# EAGLE schematic Resistor_Resistor (EAGLE 8.3.0), part 22 of 43
## Parts (continued)
R30118  10K  RESISTOR_0201  [0201]
R30119  10K  RESISTOR_0201  [0201]
R30120  10K  RESISTOR_0201  [0201]
R30121  10K  RESISTOR_0201  [0201]
R30122  10K  RESISTOR_0201  [0201]
R30123  10K  RESISTOR_0201  [0201]
R30124  10K  RESISTOR_0201  [0201]
R30125  10K  RESISTOR_0201  [0201]
R30126  10K  RESISTOR_0201  [0201]
R30127  10K  RESISTOR_0201  [0201]
R30128  10K  RESISTOR_0201  [0201]
R30129  10K  RESISTOR_0201  [0201]
R30130  10K  RESISTOR_0201  [0201]
R30131  10K  RESISTOR_0201  [0201]
R30132  10K  RESISTOR_0201  [0201]
R30133  10K  RESISTOR_0201  [0201]
R30134  10K  RESISTOR_0201  [0201]
R30135  10K  RESISTOR_0201  [0201]
R30136  10K  RESISTOR_0201  [0201]
R30137  10K  RESISTOR_0201  [0201]
R30138  10K  RESISTOR_0201  [0201]
R30139  10K  RESISTOR_0201  [0201]
R30140  10K  RESISTOR_0201  [0201]
R30141  10K  RESISTOR_0201  [0201]
R30142  10K  RESISTOR_0201  [0201]
R30143  10K  RESISTOR_0201  [0201]
R30144  10K  RESISTOR_0201  [0201]
R30145  10K  RESISTOR_0201  [0201]
R30146  10K  RESISTOR_0201  [0201]
R30147  10K  RESISTOR_0201  [0201]
R30148  10K  RESISTOR_0201  [0201]
R30149  10K  RESISTOR_0201  [0201]
R30150  10K  RESISTOR_0201  [0201]
R30151  10K  RESISTOR_0201  [0201]
R30152  10K  RESISTOR_0201  [0201]
R30153  10K  RESISTOR_0201  [0201]
R30154  10K  RESISTOR_0201  [0201]
R30155  10K  RESISTOR_0201  [0201]
R30156  10K  RESISTOR_0201  [0201]
R30157  10K  RESISTOR_0201  [0201]
R30158  10K  RESISTOR_0201  [0201]
R30159  10K  RESISTOR_0201  [0201]
R30160  10K  RESISTOR_0201  [0201]
R30161  10K  RESISTOR_0201  [0201]
R30162  10K  RESISTOR_0201  [0201]
R30163  10K  RESISTOR_0201  [0201]
R30164  10K  RESISTOR_0201  [0201]
R30165  10K  RESISTOR_0201  [0201]
R30166  10K  RESISTOR_0201  [0201]
R30167  10K  RESISTOR_0201  [0201]
R30168  10K  RESISTOR_0201  [0201]
R30169  10K  RESISTOR_0201  [0201]
R30170  10K  RESISTOR_0201  [0201]
R30171  10K  RESISTOR_0201  [0201]
R30172  10K  RESISTOR_0201  [0201]
R30173  10K  RESISTOR_0201  [0201]
R30174  10K  RESISTOR_0201  [0201]
R30175  10K  RESISTOR_0201  [0201]
R30176  10K  RESISTOR_0201  [0201]
R30177  10K  RESISTOR_0201  [0201]
R30178  10K  RESISTOR_0201  [0201]
R30179  10K  RESISTOR_0201  [0201]
R30180  10K  RESISTOR_0201  [0201]
R30181  10K  RESISTOR_0201  [0201]
R30182  10K  RESISTOR_0201  [0201]
R30183  10K  RESISTOR_0201  [0201]
R30184  10K  RESISTOR_0201  [0201]
R30185  10K  RESISTOR_0201  [0201]
R30186  10K  RESISTOR_0201  [0201]
R30187  10K  RESISTOR_0201  [0201]
R30188  10K  RESISTOR_0201  [0201]
R30189  10K  RESISTOR_0201  [0201]
R30190  10K  RESISTOR_0201  [0201]
R30191  10K  RESISTOR_0201  [0201]
R30192  10K  RESISTOR_0201  [0201]
R30193  10K  RESISTOR_0201  [0201]
R30194  10K  RESISTOR_0201  [0201]
R30195  10K  RESISTOR_0201  [0201]
R30196  10K  RESISTOR_0201  [0201]
R30197  10K  RESISTOR_0201  [0201]
R30198  10K  RESISTOR_0201  [0201]
R30199  10K  RESISTOR_0201  [0201]
R30200  10K  RESISTOR_0201  [0201]
R30201  10K  RESISTOR_0201  [0201]
R30202  10K  RESISTOR_0201  [0201]
R30203  10K  RESISTOR_0201  [0201]
R30204  10K  RESISTOR_0201  [0201]
R30205  10K  RESISTOR_0201  [0201]
R30206  10K  RESISTOR_0201  [0201]
R30207  10K  RESISTOR_0201  [0201]
R30208  10K  RESISTOR_0201  [0201]
R30209  10K  RESISTOR_0201  [0201]
R30210  10K  RESISTOR_0201  [0201]
R30211  10K  RESISTOR_0201  [0201]
R30212  10K  RESISTOR_0201  [0201]
R30213  10K  RESISTOR_0201  [0201]
R30214  10K  RESISTOR_0201  [0201]
R30215  10K  RESISTOR_0201  [0201]
R30216  10K  RESISTOR_0201  [0201]
R30217  10K  RESISTOR_0201  [0201]
R30218  10K  RESISTOR_0201  [0201]
R30219  10K  RESISTOR_0201  [0201]
R30220  10K  RESISTOR_0201  [0201]
R30221  10K  RESISTOR_0201  [0201]
R30222  10K  RESISTOR_0201  [0201]
R30223  10K  RESISTOR_0201  [0201]
R30224  10K  RESISTOR_0201  [0201]
R30225  10K  RESISTOR_0201  [0201]
R30226  10K  RESISTOR_0201  [0201]
R30227  10K  RESISTOR_0201  [0201]
R30228  10K  RESISTOR_0201  [0201]
R30229  10K  RESISTOR_0201  [0201]
R30230  10K  RESISTOR_0201  [0201]
R30231  10K  RESISTOR_0201  [0201]
R30232  10K  RESISTOR_0201  [0201]
R30233  10K  RESISTOR_0201  [0201]
R30234  10K  RESISTOR_0201  [0201]
R30235  10K  RESISTOR_0201  [0201]
R30236  10K  RESISTOR_0201  [0201]
R30237  10K  RESISTOR_0201  [0201]
R30238  10K  RESISTOR_0201  [0201]
R30239  10K  RESISTOR_0201  [0201]
R30240  10K  RESISTOR_0201  [0201]
R30241  10K  RESISTOR_0201  [0201]
R30242  10K  RESISTOR_0201  [0201]
R30243  10K  RESISTOR_0201  [0201]
R30244  10K  RESISTOR_0201  [0201]
R30245  10K  RESISTOR_0201  [0201]
R30246  10K  RESISTOR_0201  [0201]
R30247  10K  RESISTOR_0201  [0201]
R30248  10K  RESISTOR_0201  [0201]
R30249  10K  RESISTOR_0201  [0201]
R30250  10K  RESISTOR_0201  [0201]
R30251  10K  RESISTOR_0201  [0201]
R30252  10K  RESISTOR_0201  [0201]
R30253  10K  RESISTOR_0201  [0201]
R30254  10K  RESISTOR_0201  [0201]
R30255  10K  RESISTOR_0201  [0201]
R30256  10K  RESISTOR_0201  [0201]
R30257  10K  RESISTOR_0201  [0201]
R30258  10K  RESISTOR_0201  [0201]
R30259  10K  RESISTOR_0201  [0201]
R30260  10K  RESISTOR_0201  [0201]
R30261  10K  RESISTOR_0201  [0201]
R30262  10K  RESISTOR_0201  [0201]
R30263  10K  RESISTOR_0201  [0201]
R30264  10K  RESISTOR_0201  [0201]
R30265  10K  RESISTOR_0201  [0201]
R30266  10K  RESISTOR_0201  [0201]
R30267  10K  RESISTOR_0201  [0201]
R30268  10K  RESISTOR_0201  [0201]
R30269  10K  RESISTOR_0201  [0201]
R30270  10K  RESISTOR_0201  [0201]
R30271  10K  RESISTOR_0201  [0201]
R30272  10K  RESISTOR_0201  [0201]
R30273  10K  RESISTOR_0201  [0201]
R30274  10K  RESISTOR_0201  [0201]
R30275  10K  RESISTOR_0201  [0201]
R30276  10K  RESISTOR_0201  [0201]
R30277  10K  RESISTOR_0201  [0201]
R30278  10K  RESISTOR_0201  [0201]
R30279  10K  RESISTOR_0201  [0201]
R30280  10K  RESISTOR_0201  [0201]
R30281  10K  RESISTOR_0201  [0201]
R30282  10K  RESISTOR_0201  [0201]
R30283  10K  RESISTOR_0201  [0201]
R30284  10K  RESISTOR_0201  [0201]
R30285  10K  RESISTOR_0201  [0201]
R30286  10K  RESISTOR_0201  [0201]
R30287  10K  RESISTOR_0201  [0201]
R30288  10K  RESISTOR_0201  [0201]
R30289  10K  RESISTOR_0201  [0201]
R30290  10K  RESISTOR_0201  [0201]
R30291  10K  RESISTOR_0201  [0201]
R30292  10K  RESISTOR_0201  [0201]
R30293  10K  RESISTOR_0201  [0201]
R30294  10K  RESISTOR_0201  [0201]
R30295  10K  RESISTOR_0201  [0201]
R30296  10K  RESISTOR_0201  [0201]
R30297  10K  RESISTOR_0201  [0201]
R30298  10K  RESISTOR_0201  [0201]
R30299  10K  RESISTOR_0201  [0201]
R30300  10K  RESISTOR_0201  [0201]
R30301  10K  RESISTOR_0201  [0201]
R30302  10K  RESISTOR_0201  [0201]
R30303  10K  RESISTOR_0201  [0201]
R30304  10K  RESISTOR_0201  [0201]
R30305  10K  RESISTOR_0201  [0201]
R30306  10K  RESISTOR_0201  [0201]
R30307  10K  RESISTOR_0201  [0201]
R30308  10K  RESISTOR_0201  [0201]
R30309  10K  RESISTOR_0201  [0201]
R30310  10K  RESISTOR_0201  [0201]
R30311  10K  RESISTOR_0201  [0201]
R30312  10K  RESISTOR_0201  [0201]
R30313  10K  RESISTOR_0201  [0201]
R30314  10K  RESISTOR_0201  [0201]
R30315  10K  RESISTOR_0201  [0201]
R30316  10K  RESISTOR_0201  [0201]
R30317  10K  RESISTOR_0201  [0201]
R30318  10K  RESISTOR_0201  [0201]
R30319  10K  RESISTOR_0201  [0201]
R30320  10K  RESISTOR_0201  [0201]
R30321  10K  RESISTOR_0201  [0201]
R30322  10K  RESISTOR_0201  [0201]
R30323  10K  RESISTOR_0201  [0201]
R30324  10K  RESISTOR_0201  [0201]
R30325  10K  RESISTOR_0201  [0201]
R30326  10K  RESISTOR_0201  [0201]
R30327  10K  RESISTOR_0201  [0201]
R30328  10K  RESISTOR_0201  [0201]
R30329  10K  RESISTOR_0201  [0201]
R30330  10K  RESISTOR_0201  [0201]
R30331  10K  RESISTOR_0201  [0201]
R30332  10K  RESISTOR_0201  [0201]
R30333  10K  RESISTOR_0201  [0201]
R30334  10K  RESISTOR_0201  [0201]
R30335  10K  RESISTOR_0201  [0201]
R30336  10K  RESISTOR_0201  [0201]
R30337  10K  RESISTOR_0201  [0201]
R30338  10K  RESISTOR_0201  [0201]
R30339  10K  RESISTOR_0201  [0201]
R30340  10K  RESISTOR_0201  [0201]
R30341  10K  RESISTOR_0201  [0201]
R30342  10K  RESISTOR_0201  [0201]
R30343  10K  RESISTOR_0201  [0201]
R30344  10K  RESISTOR_0201  [0201]
R30345  10K  RESISTOR_0201  [0201]
R30346  10K  RESISTOR_0201  [0201]
R30347  10K  RESISTOR_0201  [0201]
R30348  10K  RESISTOR_0201  [0201]
R30349  10K  RESISTOR_0201  [0201]
R30350  10K  RESISTOR_0201  [0201]
R30351  10K  RESISTOR_0201  [0201]
R30352  10K  RESISTOR_0201  [0201]
R30353  10K  RESISTOR_0201  [0201]
R30354  10K  RESISTOR_0201  [0201]
R30355  10K  RESISTOR_0201  [0201]
R30356  10K  RESISTOR_0201  [0201]
R30357  10K  RESISTOR_0201  [0201]
R30358  10K  RESISTOR_0201  [0201]
R30359  10K  RESISTOR_0201  [0201]
R30360  10K  RESISTOR_0201  [0201]
R30361  10K  RESISTOR_0201  [0201]
R30362  10K  RESISTOR_0201  [0201]
R30363  10K  RESISTOR_0201  [0201]
R30364  10K  RESISTOR_0201  [0201]
R30365  10K  RESISTOR_0201  [0201]
R30366  10K  RESISTOR_0201  [0201]
R30367  10K  RESISTOR_0201  [0201]
R30368  10K  RESISTOR_0201  [0201]
R30369  10K  RESISTOR_0201  [0201]
R30370  10K  RESISTOR_0201  [0201]
R30371  10K  RESISTOR_0201  [0201]
R30372  10K  RESISTOR_0201  [0201]
R30373  10K  RESISTOR_0201  [0201]
R30374  10K  RESISTOR_0201  [0201]
R30375  10K  RESISTOR_0201  [0201]
R30376  10K  RESISTOR_0201  [0201]
R30377  10K  RESISTOR_0201  [0201]
R30378  10K  RESISTOR_0201  [0201]
R30379  10K  RESISTOR_0201  [0201]
R30380  10K  RESISTOR_0201  [0201]
R30381  10K  RESISTOR_0201  [0201]
R30382  10K  RESISTOR_0201  [0201]
R30383  10K  RESISTOR_0201  [0201]
R30384  10K  RESISTOR_0201  [0201]
R30385  10K  RESISTOR_0201  [0201]
R30386  10K  RESISTOR_0201  [0201]
R30387  10K  RESISTOR_0201  [0201]
R30388  10K  RESISTOR_0201  [0201]
R30389  10K  RESISTOR_0201  [0201]
R30390  10K  RESISTOR_0201  [0201]
R30391  10K  RESISTOR_0201  [0201]
R30392  10K  RESISTOR_0201  [0201]
R30393  10K  RESISTOR_0201  [0201]
R30394  10K  RESISTOR_0201  [0201]
R30395  10K  RESISTOR_0201  [0201]
R30396  10K  RESISTOR_0201  [0201]
R30397  10K  RESISTOR_0201  [0201]
R30398  10K  RESISTOR_0201  [0201]
R30399  10K  RESISTOR_0201  [0201]
R30400  10K  RESISTOR_0201  [0201]
R30401  10K  RESISTOR_0201  [0201]
R30402  10K  RESISTOR_0201  [0201]
R30403  10K  RESISTOR_0201  [0201]
R30404  10K  RESISTOR_0201  [0201]
R30405  10K  RESISTOR_0201  [0201]
R30406  10K  RESISTOR_0201  [0201]
R30407  10K  RESISTOR_0201  [0201]
R30408  10K  RESISTOR_0201  [0201]
R30409  10K  RESISTOR_0201  [0201]
R30410  10K  RESISTOR_0201  [0201]
R30411  10K  RESISTOR_0201  [0201]
R30412  10K  RESISTOR_0201  [0201]
R30413  10K  RESISTOR_0201  [0201]
R30414  10K  RESISTOR_0201  [0201]
R30415  10K  RESISTOR_0201  [0201]
R30416  10K  RESISTOR_0201  [0201]
R30417  10K  RESISTOR_0201  [0201]
R30418  10K  RESISTOR_0201  [0201]
R30419  10K  RESISTOR_0201  [0201]
R30420  10K  RESISTOR_0201  [0201]
R30421  10K  RESISTOR_0201  [0201]
R30422  10K  RESISTOR_0201  [0201]
R30423  10K  RESISTOR_0201  [0201]
R30424  10K  RESISTOR_0201  [0201]
R30425  10K  RESISTOR_0201  [0201]
R30426  10K  RESISTOR_0201  [0201]
R30427  10K  RESISTOR_0201  [0201]
R30428  10K  RESISTOR_0201  [0201]
R30429  10K  RESISTOR_0201  [0201]
R30430  10K  RESISTOR_0201  [0201]
R30431  10K  RESISTOR_0201  [0201]
R30432  10K  RESISTOR_0201  [0201]
R30433  10K  RESISTOR_0201  [0201]
R30434  10K  RESISTOR_0201  [0201]
R30435  10K  RESISTOR_0201  [0201]
R30436  10K  RESISTOR_0201  [0201]
R30437  10K  RESISTOR_0201  [0201]
R30438  10K  RESISTOR_0201  [0201]
R30439  10K  RESISTOR_0201  [0201]
R30440  10K  RESISTOR_0201  [0201]
R30441  10K  RESISTOR_0201  [0201]
R30442  10K  RESISTOR_0201  [0201]
R30443  10K  RESISTOR_0201  [0201]
R30444  10K  RESISTOR_0201  [0201]
R30445  10K  RESISTOR_0201  [0201]
R30446  10K  RESISTOR_0201  [0201]
R30447  10K  RESISTOR_0201  [0201]
R30448  10K  RESISTOR_0201  [0201]
R30449  10K  RESISTOR_0201  [0201]
R30450  10K  RESISTOR_0201  [0201]
R30451  10K  RESISTOR_0201  [0201]
R30452  10K  RESISTOR_0201  [0201]
R30453  10K  RESISTOR_0201  [0201]
R30454  10K  RESISTOR_0201  [0201]
R30455  10K  RESISTOR_0201  [0201]
R30456  10K  RESISTOR_0201  [0201]
R30457  10K  RESISTOR_0201  [0201]
R30458  10K  RESISTOR_0201  [0201]
R30459  10K  RESISTOR_0201  [0201]
R30460  10K  RESISTOR_0201  [0201]
R30461  10K  RESISTOR_0201  [0201]
R30462  10K  RESISTOR_0201  [0201]
R30463  10K  RESISTOR_0201  [0201]
R30464  10K  RESISTOR_0201  [0201]
R30465  10K  RESISTOR_0201  [0201]
R30466  10K  RESISTOR_0201  [0201]
R30467  10K  RESISTOR_0201  [0201]
R30468  10K  RESISTOR_0201  [0201]
R30469  10K  RESISTOR_0201  [0201]
R30470  10K  RESISTOR_0201  [0201]
R30471  10K  RESISTOR_0201  [0201]
R30472  10K  RESISTOR_0201  [0201]
R30473  10K  RESISTOR_0201  [0201]
R30474  10K  RESISTOR_0201  [0201]
R30475  10K  RESISTOR_0201  [0201]
R30476  10K  RESISTOR_0201  [0201]
R30477  10K  RESISTOR_0201  [0201]
R30478  10K  RESISTOR_0201  [0201]
R30479  10K  RESISTOR_0201  [0201]
R30480  10K  RESISTOR_0201  [0201]
R30481  10K  RESISTOR_0201  [0201]
R30482  10K  RESISTOR_0201  [0201]
R30483  10K  RESISTOR_0201  [0201]
R30484  10K  RESISTOR_0201  [0201]
R30485  10K  RESISTOR_0201  [0201]
R30486  10K  RESISTOR_0201  [0201]
R30487  10K  RESISTOR_0201  [0201]
R30488  10K  RESISTOR_0201  [0201]
R30489  10K  RESISTOR_0201  [0201]
R30490  10K  RESISTOR_0201  [0201]
R30491  10K  RESISTOR_0201  [0201]
R30492  10K  RESISTOR_0201  [0201]
R30493  10K  RESISTOR_0201  [0201]
R30494  10K  RESISTOR_0201  [0201]
R30495  10K  RESISTOR_0201  [0201]
R30496  10K  RESISTOR_0201  [0201]
R30497  10K  RESISTOR_0201  [0201]
R30498  10K  RESISTOR_0201  [0201]
R30499  10K  RESISTOR_0201  [0201]
R30500  10K  RESISTOR_0201  [0201]
R30501  10K  RESISTOR_0201  [0201]
R30502  10K  RESISTOR_0201  [0201]
R30503  10K  RESISTOR_0201  [0201]
R30504  10K  RESISTOR_0201  [0201]
R30505  10K  RESISTOR_0201  [0201]
R30506  10K  RESISTOR_0201  [0201]
R30507  10K  RESISTOR_0201  [0201]
R30508  10K  RESISTOR_0201  [0201]
R30509  10K  RESISTOR_0201  [0201]
R30510  10K  RESISTOR_0201  [0201]
R30511  10K  RESISTOR_0201  [0201]
R30512  10K  RESISTOR_0201  [0201]
R30513  10K  RESISTOR_0201  [0201]
R30514  10K  RESISTOR_0201  [0201]
R30515  10K  RESISTOR_0201  [0201]
R30516  10K  RESISTOR_0201  [0201]
R30517  10K  RESISTOR_0201  [0201]
R30518  10K  RESISTOR_0201  [0201]
R30519  10K  RESISTOR_0201  [0201]
R30520  10K  RESISTOR_0201  [0201]
R30521  10K  RESISTOR_0201  [0201]
R30522  10K  RESISTOR_0201  [0201]
R30523  10K  RESISTOR_0201  [0201]
R30524  10K  RESISTOR_0201  [0201]
R30525  10K  RESISTOR_0201  [0201]
R30526  10K  RESISTOR_0201  [0201]
R30527  10K  RESISTOR_0201  [0201]
R30528  10K  RESISTOR_0201  [0201]
R30529  10K  RESISTOR_0201  [0201]
R30530  10K  RESISTOR_0201  [0201]
R30531  10K  RESISTOR_0201  [0201]
R30532  10K  RESISTOR_0201  [0201]
R30533  10K  RESISTOR_0201  [0201]
R30534  10K  RESISTOR_0201  [0201]
R30535  10K  RESISTOR_0201  [0201]
R30536  10K  RESISTOR_0201  [0201]
R30537  10K  RESISTOR_0201  [0201]
R30538  10K  RESISTOR_0201  [0201]
R30539  10K  RESISTOR_0201  [0201]
R30540  10K  RESISTOR_0201  [0201]
R30541  10K  RESISTOR_0201  [0201]
R30542  10K  RESISTOR_0201  [0201]
R30543  10K  RESISTOR_0201  [0201]
R30544  10K  RESISTOR_0201  [0201]
R30545  10K  RESISTOR_0201  [0201]
R30546  10K  RESISTOR_0201  [0201]
R30547  10K  RESISTOR_0201  [0201]
R30548  10K  RESISTOR_0201  [0201]
R30549  10K  RESISTOR_0201  [0201]
R30550  10K  RESISTOR_0201  [0201]
R30551  10K  RESISTOR_0201  [0201]
R30552  10K  RESISTOR_0201  [0201]
R30553  10K  RESISTOR_0201  [0201]
R30554  10K  RESISTOR_0201  [0201]
R30555  10K  RESISTOR_0201  [0201]
R30556  10K  RESISTOR_0201  [0201]
R30557  10K  RESISTOR_0201  [0201]
R30558  10K  RESISTOR_0201  [0201]
R30559  10K  RESISTOR_0201  [0201]
R30560  10K  RESISTOR_0201  [0201]
R30561  10K  RESISTOR_0201  [0201]
R30562  10K  RESISTOR_0201  [0201]
R30563  10K  RESISTOR_0201  [0201]
R30564  10K  RESISTOR_0201  [0201]
R30565  10K  RESISTOR_0201  [0201]
R30566  10K  RESISTOR_0201  [0201]
R30567  10K  RESISTOR_0201  [0201]
R30568  10K  RESISTOR_0201  [0201]
R30569  10K  RESISTOR_0201  [0201]
R30570  10K  RESISTOR_0201  [0201]
R30571  10K  RESISTOR_0201  [0201]
R30572  10K  RESISTOR_0201  [0201]
R30573  10K  RESISTOR_0201  [0201]
R30574  10K  RESISTOR_0201  [0201]
R30575  10K  RESISTOR_0201  [0201]
R30576  10K  RESISTOR_0201  [0201]
R30577  10K  RESISTOR_0201  [0201]
R30578  10K  RESISTOR_0201  [0201]
R30579  10K  RESISTOR_0201  [0201]
R30580  10K  RESISTOR_0201  [0201]
R30581  10K  RESISTOR_0201  [0201]
R30582  10K  RESISTOR_0201  [0201]
R30583  10K  RESISTOR_0201  [0201]
R30584  10K  RESISTOR_0201  [0201]
R30585  10K  RESISTOR_0201  [0201]
R30586  10K  RESISTOR_0201  [0201]
R30587  10K  RESISTOR_0201  [0201]
R30588  10K  RESISTOR_0201  [0201]
R30589  10K  RESISTOR_0201  [0201]
R30590  10K  RESISTOR_0201  [0201]
R30591  10K  RESISTOR_0201  [0201]
R30592  10K  RESISTOR_0201  [0201]
R30593  10K  RESISTOR_0201  [0201]
R30594  10K  RESISTOR_0201  [0201]
R30595  10K  RESISTOR_0201  [0201]
R30596  10K  RESISTOR_0201  [0201]
R30597  10K  RESISTOR_0201  [0201]
R30598  10K  RESISTOR_0201  [0201]
R30599  10K  RESISTOR_0201  [0201]
R30600  10K  RESISTOR_0201  [0201]
R30601  10K  RESISTOR_0201  [0201]
R30602  10K  RESISTOR_0201  [0201]
R30603  10K  RESISTOR_0201  [0201]
R30604  10K  RESISTOR_0201  [0201]
R30605  10K  RESISTOR_0201  [0201]
R30606  10K  RESISTOR_0201  [0201]
R30607  10K  RESISTOR_0201  [0201]
R30608  10K  RESISTOR_0201  [0201]
R30609  10K  RESISTOR_0201  [0201]
R30610  10K  RESISTOR_0201  [0201]
R30611  10K  RESISTOR_0201  [0201]
R30612  10K  RESISTOR_0201  [0201]
R30613  10K  RESISTOR_0201  [0201]
R30614  10K  RESISTOR_0201  [0201]
R30615  10K  RESISTOR_0201  [0201]
R30616  10K  RESISTOR_0201  [0201]
R30617  10K  RESISTOR_0201  [0201]
R30618  10K  RESISTOR_0201  [0201]
R30619  10K  RESISTOR_0201  [0201]
R30620  10K  RESISTOR_0201  [0201]
R30621  10K  RESISTOR_0201  [0201]
R30622  10K  RESISTOR_0201  [0201]
R30623  10K  RESISTOR_0201  [0201]
R30624  10K  RESISTOR_0201  [0201]
R30625  10K  RESISTOR_0201  [0201]
R30626  10K  RESISTOR_0201  [0201]
R30627  10K  RESISTOR_0201  [0201]
R30628  10K  RESISTOR_0201  [0201]
R30629  10K  RESISTOR_0201  [0201]
R30630  10K  RESISTOR_0201  [0201]
R30631  10K  RESISTOR_0201  [0201]
R30632  10K  RESISTOR_0201  [0201]
R30633  10K  RESISTOR_0201  [0201]
R30634  10K  RESISTOR_0201  [0201]
R30635  10K  RESISTOR_0201  [0201]
R30636  10K  RESISTOR_0201  [0201]
R30637  10K  RESISTOR_0201  [0201]
R30638  10K  RESISTOR_0201  [0201]
R30639  10K  RESISTOR_0201  [0201]
R30640  10K  RESISTOR_0201  [0201]
R30641  10K  RESISTOR_0201  [0201]
R30642  10K  RESISTOR_0201  [0201]
R30643  10K  RESISTOR_0201  [0201]
R30644  10K  RESISTOR_0201  [0201]
R30645  10K  RESISTOR_0201  [0201]
R30646  10K  RESISTOR_0201  [0201]
R30647  10K  RESISTOR_0201  [0201]
R30648  10K  RESISTOR_0201  [0201]
R30649  10K  RESISTOR_0201  [0201]
R30650  10K  RESISTOR_0201  [0201]
R30651  10K  RESISTOR_0201  [0201]
R30652  10K  RESISTOR_0201  [0201]
R30653  10K  RESISTOR_0201  [0201]
R30654  10K  RESISTOR_0201  [0201]
R30655  10K  RESISTOR_0201  [0201]
R30656  10K  RESISTOR_0201  [0201]
R30657  10K  RESISTOR_0201  [0201]
R30658  10K  RESISTOR_0201  [0201]
R30659  10K  RESISTOR_0201  [0201]
R30660  10K  RESISTOR_0201  [0201]
R30661  10K  RESISTOR_0201  [0201]
R30662  10K  RESISTOR_0201  [0201]
R30663  10K  RESISTOR_0201  [0201]
R30664  10K  RESISTOR_0201  [0201]
R30665  10K  RESISTOR_0201  [0201]
R30666  10K  RESISTOR_0201  [0201]
R30667  10K  RESISTOR_0201  [0201]
R30668  10K  RESISTOR_0201  [0201]
R30669  10K  RESISTOR_0201  [0201]
R30670  10K  RESISTOR_0201  [0201]
R30671  10K  RESISTOR_0201  [0201]
R30672  10K  RESISTOR_0201  [0201]
R30673  10K  RESISTOR_0201  [0201]
R30674  10K  RESISTOR_0201  [0201]
R30675  10K  RESISTOR_0201  [0201]
R30676  10K  RESISTOR_0201  [0201]
R30677  10K  RESISTOR_0201  [0201]
R30678  10K  RESISTOR_0201  [0201]
R30679  10K  RESISTOR_0201  [0201]
R30680  10K  RESISTOR_0201  [0201]
R30681  10K  RESISTOR_0201  [0201]
R30682  10K  RESISTOR_0201  [0201]
R30683  10K  RESISTOR_0201  [0201]
R30684  10K  RESISTOR_0201  [0201]
R30685  10K  RESISTOR_0201  [0201]
R30686  10K  RESISTOR_0201  [0201]
R30687  10K  RESISTOR_0201  [0201]
R30688  10K  RESISTOR_0201  [0201]
R30689  10K  RESISTOR_0201  [0201]
R30690  10K  RESISTOR_0201  [0201]
R30691  10K  RESISTOR_0201  [0201]
R30692  10K  RESISTOR_0201  [0201]
R30693  10K  RESISTOR_0201  [0201]
R30694  10K  RESISTOR_0201  [0201]
R30695  10K  RESISTOR_0201  [0201]
R30696  10K  RESISTOR_0201  [0201]
R30697  10K  RESISTOR_0201  [0201]
R30698  10K  RESISTOR_0201  [0201]
R30699  10K  RESISTOR_0201  [0201]
R30700  10K  RESISTOR_0201  [0201]
R30701  10K  RESISTOR_0201  [0201]
R30702  10K  RESISTOR_0201  [0201]
R30703  10K  RESISTOR_0201  [0201]
R30704  10K  RESISTOR_0201  [0201]
R30705  10K  RESISTOR_0201  [0201]
R30706  10K  RESISTOR_0201  [0201]
R30707  10K  RESISTOR_0201  [0201]
R30708  10K  RESISTOR_0201  [0201]
R30709  10K  RESISTOR_0201  [0201]
R30710  10K  RESISTOR_0201  [0201]
R30711  10K  RESISTOR_0201  [0201]
R30712  10K  RESISTOR_0201  [0201]
R30713  10K  RESISTOR_0201  [0201]
R30714  10K  RESISTOR_0201  [0201]
R30715  10K  RESISTOR_0201  [0201]
R30716  10K  RESISTOR_0201  [0201]
R30717  10K  RESISTOR_0201  [0201]
R30718  10K  RESISTOR_0201  [0201]
R30719  10K  RESISTOR_0201  [0201]
R30720  10K  RESISTOR_0201  [0201]
R30721  10K  RESISTOR_0201  [0201]
R30722  10K  RESISTOR_0201  [0201]
R30723  10K  RESISTOR_0201  [0201]
R30724  10K  RESISTOR_0201  [0201]
R30725  10K  RESISTOR_0201  [0201]
R30726  10K  RESISTOR_0201  [0201]
R30727  10K  RESISTOR_0201  [0201]
R30728  10K  RESISTOR_0201  [0201]
R30729  10K  RESISTOR_0201  [0201]
R30730  10K  RESISTOR_0201  [0201]
R30731  10K  RESISTOR_0201  [0201]
R30732  10K  RESISTOR_0201  [0201]
R30733  10K  RESISTOR_0201  [0201]
R30734  10K  RESISTOR_0201  [0201]
R30735  10K  RESISTOR_0201  [0201]
R30736  10K  RESISTOR_0201  [0201]
R30737  10K  RESISTOR_0201  [0201]
R30738  10K  RESISTOR_0201  [0201]
R30739  10K  RESISTOR_0201  [0201]
R30740  10K  RESISTOR_0201  [0201]
R30741  10K  RESISTOR_0201  [0201]
R30742  10K  RESISTOR_0201  [0201]
R30743  10K  RESISTOR_0201  [0201]
R30744  10K  RESISTOR_0201  [0201]
R30745  10K  RESISTOR_0201  [0201]
R30746  10K  RESISTOR_0201  [0201]
R30747  10K  RESISTOR_0201  [0201]
R30748  10K  RESISTOR_0201  [0201]
R30749  10K  RESISTOR_0201  [0201]
R30750  10K  RESISTOR_0201  [0201]
R30751  10K  RESISTOR_0201  [0201]
R30752  10K  RESISTOR_0201  [0201]
R30753  10K  RESISTOR_0201  [0201]
R30754  10K  RESISTOR_0201  [0201]
R30755  10K  RESISTOR_0201  [0201]
R30756  10K  RESISTOR_0201  [0201]
R30757  10K  RESISTOR_0201  [0201]
R30758  10K  RESISTOR_0201  [0201]
R30759  10K  RESISTOR_0201  [0201]
R30760  10K  RESISTOR_0201  [0201]
R30761  10K  RESISTOR_0201  [0201]
R30762  10K  RESISTOR_0201  [0201]
R30763  10K  RESISTOR_0201  [0201]
R30764  10K  RESISTOR_0201  [0201]
R30765  10K  RESISTOR_0201  [0201]
R30766  10K  RESISTOR_0201  [0201]
R30767  10K  RESISTOR_0201  [0201]
R30768  10K  RESISTOR_0201  [0201]
R30769  10K  RESISTOR_0201  [0201]
R30770  10K  RESISTOR_0201  [0201]
R30771  10K  RESISTOR_0201  [0201]
R30772  10K  RESISTOR_0201  [0201]
R30773  10K  RESISTOR_0201  [0201]
R30774  10K  RESISTOR_0201  [0201]
R30775  10K  RESISTOR_0201  [0201]
R30776  10K  RESISTOR_0201  [0201]
R30777  10K  RESISTOR_0201  [0201]
R30778  10K  RESISTOR_0201  [0201]
R30779  10K  RESISTOR_0201  [0201]
R30780  10K  RESISTOR_0201  [0201]
R30781  10K  RESISTOR_0201  [0201]
R30782  10K  RESISTOR_0201  [0201]
R30783  10K  RESISTOR_0201  [0201]
R30784  10K  RESISTOR_0201  [0201]
R30785  10K  RESISTOR_0201  [0201]
R30786  10K  RESISTOR_0201  [0201]
R30787  10K  RESISTOR_0201  [0201]
R30788  10K  RESISTOR_0201  [0201]
R30789  10K  RESISTOR_0201  [0201]
R30790  10K  RESISTOR_0201  [0201]
R30791  10K  RESISTOR_0201  [0201]
R30792  10K  RESISTOR_0201  [0201]
R30793  10K  RESISTOR_0201  [0201]
R30794  10K  RESISTOR_0201  [0201]
R30795  10K  RESISTOR_0201  [0201]
R30796  10K  RESISTOR_0201  [0201]
R30797  10K  RESISTOR_0201  [0201]
R30798  10K  RESISTOR_0201  [0201]
R30799  10K  RESISTOR_0201  [0201]
R30800  10K  RESISTOR_0201  [0201]
R30801  10K  RESISTOR_0201  [0201]
R30802  10K  RESISTOR_0201  [0201]
R30803  10K  RESISTOR_0201  [0201]
R30804  10K  RESISTOR_0201  [0201]
R30805  10K  RESISTOR_0201  [0201]
R30806  10K  RESISTOR_0201  [0201]
R30807  10K  RESISTOR_0201  [0201]
R30808  10K  RESISTOR_0201  [0201]
R30809  10K  RESISTOR_0201  [0201]
R30810  10K  RESISTOR_0201  [0201]
R30811  10K  RESISTOR_0201  [0201]
R30812  10K  RESISTOR_0201  [0201]
R30813  10K  RESISTOR_0201  [0201]
R30814  10K  RESISTOR_0201  [0201]
R30815  10K  RESISTOR_0201  [0201]
R30816  10K  RESISTOR_0201  [0201]
R30817  10K  RESISTOR_0201  [0201]
R30818  10K  RESISTOR_0201  [0201]
R30819  10K  RESISTOR_0201  [0201]
R30820  10K  RESISTOR_0201  [0201]
R30821  10K  RESISTOR_0201  [0201]
R30822  10K  RESISTOR_0201  [0201]
R30823  10K  RESISTOR_0201  [0201]
R30824  10K  RESISTOR_0201  [0201]
R30825  10K  RESISTOR_0201  [0201]
R30826  10K  RESISTOR_0201  [0201]
R30827  10K  RESISTOR_0201  [0201]
R30828  10K  RESISTOR_0201  [0201]
R30829  10K  RESISTOR_0201  [0201]
R30830  10K  RESISTOR_0201  [0201]
R30831  10K  RESISTOR_0201  [0201]
R30832  10K  RESISTOR_0201  [0201]
R30833  10K  RESISTOR_0201  [0201]
R30834  10K  RESISTOR_0201  [0201]
R30835  10K  RESISTOR_0201  [0201]
R30836  10K  RESISTOR_0201  [0201]
R30837  10K  RESISTOR_0201  [0201]
R30838  10K  RESISTOR_0201  [0201]
R30839  10K  RESISTOR_0201  [0201]
R30840  10K  RESISTOR_0201  [0201]
R30841  10K  RESISTOR_0201  [0201]
R30842  10K  RESISTOR_0201  [0201]
R30843  10K  RESISTOR_0201  [0201]
R30844  10K  RESISTOR_0201  [0201]
R30845  10K  RESISTOR_0201  [0201]
R30846  10K  RESISTOR_0201  [0201]
R30847  10K  RESISTOR_0201  [0201]
R30848  10K  RESISTOR_0201  [0201]
R30849  10K  RESISTOR_0201  [0201]
R30850  10K  RESISTOR_0201  [0201]
R30851  10K  RESISTOR_0201  [0201]
R30852  10K  RESISTOR_0201  [0201]
R30853  10K  RESISTOR_0201  [0201]
R30854  10K  RESISTOR_0201  [0201]
R30855  10K  RESISTOR_0201  [0201]
R30856  10K  RESISTOR_0201  [0201]
R30857  10K  RESISTOR_0201  [0201]
R30858  10K  RESISTOR_0201  [0201]
R30859  10K  RESISTOR_0201  [0201]
R30860  10K  RESISTOR_0201  [0201]
R30861  10K  RESISTOR_0201  [0201]
R30862  10K  RESISTOR_0201  [0201]
R30863  10K  RESISTOR_0201  [0201]
R30864  10K  RESISTOR_0201  [0201]
R30865  10K  RESISTOR_0201  [0201]
R30866  10K  RESISTOR_0201  [0201]
R30867  10K  RESISTOR_0201  [0201]
R30868  10K  RESISTOR_0201  [0201]
R30869  10K  RESISTOR_0201  [0201]
R30870  10K  RESISTOR_0201  [0201]
R30871  10K  RESISTOR_0201  [0201]
R30872  10K  RESISTOR_0201  [0201]
R30873  10K  RESISTOR_0201  [0201]
R30874  10K  RESISTOR_0201  [0201]
R30875  10K  RESISTOR_0201  [0201]
R30876  10K  RESISTOR_0201  [0201]
R30877  10K  RESISTOR_0201  [0201]
R30878  10K  RESISTOR_0201  [0201]
R30879  10K  RESISTOR_0201  [0201]
R30880  10K  RESISTOR_0201  [0201]
R30881  10K  RESISTOR_0201  [0201]
R30882  10K  RESISTOR_0201  [0201]
R30883  10K  RESISTOR_0201  [0201]
R30884  10K  RESISTOR_0201  [0201]
R30885  10K  RESISTOR_0201  [0201]
R30886  10K  RESISTOR_0201  [0201]
R30887  10K  RESISTOR_0201  [0201]
R30888  10K  RESISTOR_0201  [0201]
R30889  10K  RESISTOR_0201  [0201]
R30890  10K  RESISTOR_0201  [0201]
R30891  10K  RESISTOR_0201  [0201]
R30892  10K  RESISTOR_0201  [0201]
R30893  10K  RESISTOR_0201  [0201]
R30894  10K  RESISTOR_0201  [0201]
R30895  10K  RESISTOR_0201  [0201]
R30896  10K  RESISTOR_0201  [0201]
R30897  10K  RESISTOR_0201  [0201]
R30898  10K  RESISTOR_0201  [0201]
R30899  10K  RESISTOR_0201  [0201]
R30900  10K  RESISTOR_0201  [0201]
R30901  10K  RESISTOR_0201  [0201]
R30902  10K  RESISTOR_0201  [0201]
R30903  10K  RESISTOR_0201  [0201]
R30904  10K  RESISTOR_0201  [0201]
R30905  10K  RESISTOR_0201  [0201]
R30906  10K  RESISTOR_0201  [0201]
R30907  10K  RESISTOR_0201  [0201]
R30908  10K  RESISTOR_0201  [0201]
R30909  10K  RESISTOR_0201  [0201]
R30910  10K  RESISTOR_0201  [0201]
R30911  10K  RESISTOR_0201  [0201]
R30912  10K  RESISTOR_0201  [0201]
R30913  10K  RESISTOR_0201  [0201]
R30914  10K  RESISTOR_0201  [0201]
R30915  10K  RESISTOR_0201  [0201]
R30916  10K  RESISTOR_0201  [0201]
R30917  10K  RESISTOR_0201  [0201]
R30918  10K  RESISTOR_0201  [0201]
R30919  10K  RESISTOR_0201  [0201]
R30920  10K  RESISTOR_0201  [0201]
R30921  10K  RESISTOR_0201  [0201]
R30922  10K  RESISTOR_0201  [0201]
R30923  10K  RESISTOR_0201  [0201]
R30924  10K  RESISTOR_0201  [0201]
R30925  10K  RESISTOR_0201  [0201]
R30926  10K  RESISTOR_0201  [0201]
R30927  10K  RESISTOR_0201  [0201]
R30928  10K  RESISTOR_0201  [0201]
R30929  10K  RESISTOR_0201  [0201]
R30930  10K  RESISTOR_0201  [0201]
R30931  10K  RESISTOR_0201  [0201]
R30932  10K  RESISTOR_0201  [0201]
R30933  10K  RESISTOR_0201  [0201]
R30934  10K  RESISTOR_0201  [0201]
R30935  10K  RESISTOR_0201  [0201]
R30936  10K  RESISTOR_0201  [0201]
R30937  10K  RESISTOR_0201  [0201]
R30938  10K  RESISTOR_0201  [0201]
R30939  10K  RESISTOR_0201  [0201]
R30940  10K  RESISTOR_0201  [0201]
R30941  10K  RESISTOR_0201  [0201]
R30942  10K  RESISTOR_0201  [0201]
R30943  10K  RESISTOR_0201  [0201]
R30944  10K  RESISTOR_0201  [0201]
R30945  10K  RESISTOR_0201  [0201]
R30946  10K  RESISTOR_0201  [0201]
R30947  10K  RESISTOR_0201  [0201]
R30948  10K  RESISTOR_0201  [0201]
R30949  10K  RESISTOR_0201  [0201]
R30950  10K  RESISTOR_0201  [0201]
R30951  10K  RESISTOR_0201  [0201]
R30952  10K  RESISTOR_0201  [0201]
R30953  10K  RESISTOR_0201  [0201]
R30954  10K  RESISTOR_0201  [0201]
R30955  10K  RESISTOR_0201  [0201]
R30956  10K  RESISTOR_0201  [0201]
R30957  10K  RESISTOR_0201  [0201]
R30958  10K  RESISTOR_0201  [0201]
R30959  10K  RESISTOR_0201  [0201]
R30960  10K  RESISTOR_0201  [0201]
R30961  10K  RESISTOR_0201  [0201]
R30962  10K  RESISTOR_0201  [0201]
R30963  10K  RESISTOR_0201  [0201]
R30964  10K  RESISTOR_0201  [0201]
R30965  10K  RESISTOR_0201  [0201]
R30966  10K  RESISTOR_0201  [0201]
R30967  10K  RESISTOR_0201  [0201]
R30968  10K  RESISTOR_0201  [0201]
R30969  10K  RESISTOR_0201  [0201]
R30970  10K  RESISTOR_0201  [0201]
R30971  10K  RESISTOR_0201  [0201]
R30972  10K  RESISTOR_0201  [0201]
R30973  10K  RESISTOR_0201  [0201]
R30974  10K  RESISTOR_0201  [0201]
R30975  10K  RESISTOR_0201  [0201]
R30976  10K  RESISTOR_0201  [0201]
R30977  10K  RESISTOR_0201  [0201]
R30978  10K  RESISTOR_0201  [0201]
R30979  10K  RESISTOR_0201  [0201]
R30980  10K  RESISTOR_0201  [0201]
R30981  10K  RESISTOR_0201  [0201]
R30982  10K  RESISTOR_0201  [0201]
R30983  10K  RESISTOR_0201  [0201]
R30984  10K  RESISTOR_0201  [0201]
R30985  10K  RESISTOR_0201  [0201]
R30986  10K  RESISTOR_0201  [0201]
R30987  10K  RESISTOR_0201  [0201]
R30988  10K  RESISTOR_0201  [0201]
R30989  10K  RESISTOR_0201  [0201]
R30990  10K  RESISTOR_0201  [0201]
R30991  10K  RESISTOR_0201  [0201]
R30992  10K  RESISTOR_0201  [0201]
R30993  10K  RESISTOR_0201  [0201]
R30994  10K  RESISTOR_0201  [0201]
R30995  10K  RESISTOR_0201  [0201]
R30996  10K  RESISTOR_0201  [0201]
R30997  10K  RESISTOR_0201  [0201]
R30998  10K  RESISTOR_0201  [0201]
R30999  10K  RESISTOR_0201  [0201]
R31000  10K  RESISTOR_0201  [0201]
R31001  10K  RESISTOR_0201  [0201]
R31002  10K  RESISTOR_0201  [0201]
R31003  10K  RESISTOR_0201  [0201]
R31004  10K  RESISTOR_0201  [0201]
R31005  10K  RESISTOR_0201  [0201]
R31006  10K  RESISTOR_0201  [0201]
R31007  10K  RESISTOR_0201  [0201]
R31008  10K  RESISTOR_0201  [0201]
R31009  10K  RESISTOR_0201  [0201]
R31010  10K  RESISTOR_0201  [0201]
R31011  10K  RESISTOR_0201  [0201]
R31012  10K  RESISTOR_0201  [0201]
R31013  10K  RESISTOR_0201  [0201]
R31014  10K  RESISTOR_0201  [0201]
R31015  10K  RESISTOR_0201  [0201]
R31016  10K  RESISTOR_0201  [0201]
R31017  10K  RESISTOR_0201  [0201]
R31018  10K  RESISTOR_0201  [0201]
R31019  10K  RESISTOR_0201  [0201]
R31020  10K  RESISTOR_0201  [0201]
R31021  10K  RESISTOR_0201  [0201]
R31022  10K  RESISTOR_0201  [0201]
R31023  10K  RESISTOR_0201  [0201]
R31024  10K  RESISTOR_0201  [0201]
R31025  10K  RESISTOR_0201  [0201]
R31026  10K  RESISTOR_0201  [0201]
R31027  10K  RESISTOR_0201  [0201]
R31028  10K  RESISTOR_0201  [0201]
R31029  10K  RESISTOR_0201  [0201]
R31030  10K  RESISTOR_0201  [0201]
R31031  10K  RESISTOR_0201  [0201]
R31032  10K  RESISTOR_0201  [0201]
R31033  10K  RESISTOR_0201  [0201]
R31034  10K  RESISTOR_0201  [0201]
R31035  10K  RESISTOR_0201  [0201]
R31036  10K  RESISTOR_0201  [0201]
R31037  10K  RESISTOR_0201  [0201]
R31038  10K  RESISTOR_0201  [0201]
R31039  10K  RESISTOR_0201  [0201]
R31040  10K  RESISTOR_0201  [0201]
R31041  10K  RESISTOR_0201  [0201]
R31042  10K  RESISTOR_0201  [0201]
R31043  10K  RESISTOR_0201  [0201]
R31044  10K  RESISTOR_0201  [0201]
R31045  10K  RESISTOR_0201  [0201]
R31046  10K  RESISTOR_0201  [0201]
R31047  10K  RESISTOR_0201  [0201]
R31048  10K  RESISTOR_0201  [0201]
R31049  10K  RESISTOR_0201  [0201]
R31050  10K  RESISTOR_0201  [0201]
R31051  10K  RESISTOR_0201  [0201]
R31052  10K  RESISTOR_0201  [0201]
R31053  10K  RESISTOR_0201  [0201]
R31054  10K  RESISTOR_0201  [0201]
R31055  10K  RESISTOR_0201  [0201]
R31056  10K  RESISTOR_0201  [0201]
R31057  10K  RESISTOR_0201  [0201]
R31058  10K  RESISTOR_0201  [0201]
R31059  10K  RESISTOR_0201  [0201]
R31060  10K  RESISTOR_0201  [0201]
R31061  10K  RESISTOR_0201  [0201]
R31062  10K  RESISTOR_0201  [0201]
R31063  10K  RESISTOR_0201  [0201]
R31064  10K  RESISTOR_0201  [0201]
R31065  10K  RESISTOR_0201  [0201]
R31066  10K  RESISTOR_0201  [0201]
R31067  10K  RESISTOR_0201  [0201]
R31068  10K  RESISTOR_0201  [0201]
R31069  10K  RESISTOR_0201  [0201]
R31070  10K  RESISTOR_0201  [0201]
R31071  10K  RESISTOR_0201  [0201]
R31072  10K  RESISTOR_0201  [0201]
R31073  10K  RESISTOR_0201  [0201]
R31074  10K  RESISTOR_0201  [0201]
R31075  10K  RESISTOR_0201  [0201]
R31076  10K  RESISTOR_0201  [0201]
R31077  10K  RESISTOR_0201  [0201]
R31078  10K  RESISTOR_0201  [0201]
R31079  10K  RESISTOR_0201  [0201]
R31080  10K  RESISTOR_0201  [0201]
R31081  10K  RESISTOR_0201  [0201]
R31082  10K  RESISTOR_0201  [0201]
R31083  10K  RESISTOR_0201  [0201]
R31084  10K  RESISTOR_0201  [0201]
R31085  10K  RESISTOR_0201  [0201]
R31086  10K  RESISTOR_0201  [0201]
R31087  10K  RESISTOR_0201  [0201]
R31088  10K  RESISTOR_0201  [0201]
R31089  10K  RESISTOR_0201  [0201]
R31090  10K  RESISTOR_0201  [0201]
R31091  10K  RESISTOR_0201  [0201]
R31092  10K  RESISTOR_0201  [0201]
R31093  10K  RESISTOR_0201  [0201]
R31094  10K  RESISTOR_0201  [0201]
R31095  10K  RESISTOR_0201  [0201]
R31096  10K  RESISTOR_0201  [0201]
R31097  10K  RESISTOR_0201  [0201]
R31098  10K  RESISTOR_0201  [0201]
R31099  10K  RESISTOR_0201  [0201]
R31100  10K  RESISTOR_0201  [0201]
R31101  10K  RESISTOR_0201  [0201]
R31102  10K  RESISTOR_0201  [0201]
R31103  10K  RESISTOR_0201  [0201]
R31104  10K  RESISTOR_0201  [0201]
R31105  10K  RESISTOR_0201  [0201]
R31106  10K  RESISTOR_0201  [0201]
R31107  10K  RESISTOR_0201  [0201]
R31108  10K  RESISTOR_0201  [0201]
R31109  10K  RESISTOR_0201  [0201]
R31110  10K  RESISTOR_0201  [0201]
R31111  10K  RESISTOR_0201  [0201]
R31112  10K  RESISTOR_0201  [0201]
R31113  10K  RESISTOR_0201  [0201]
R31114  10K  RESISTOR_0201  [0201]
R31115  10K  RESISTOR_0201  [0201]
R31116  10K  RESISTOR_0201  [0201]
R31117  10K  RESISTOR_0201  [0201]
R31118  10K  RESISTOR_0201  [0201]
R31119  10K  RESISTOR_0201  [0201]
R31120  10K  RESISTOR_0201  [0201]
R31121  10K  RESISTOR_0201  [0201]
R31122  10K  RESISTOR_0201  [0201]
R31123  10K  RESISTOR_0201  [0201]
R31124  10K  RESISTOR_0201  [0201]
R31125  10K  RESISTOR_0201  [0201]
R31126  10K  RESISTOR_0201  [0201]
R31127  10K  RESISTOR_0201  [0201]
R31128  10K  RESISTOR_0201  [0201]
R31129  10K  RESISTOR_0201  [0201]
R31130  10K  RESISTOR_0201  [0201]
R31131  10K  RESISTOR_0201  [0201]
R31132  10K  RESISTOR_0201  [0201]
R31133  10K  RESISTOR_0201  [0201]
R31134  10K  RESISTOR_0201  [0201]
R31135  10K  RESISTOR_0201  [0201]
R31136  10K  RESISTOR_0201  [0201]
R31137  10K  RESISTOR_0201  [0201]
R31138  10K  RESISTOR_0201  [0201]
R31139  10K  RESISTOR_0201  [0201]
R31140  10K  RESISTOR_0201  [0201]
R31141  10K  RESISTOR_0201  [0201]
R31142  10K  RESISTOR_0201  [0201]
R31143  10K  RESISTOR_0201  [0201]
R31144  10K  RESISTOR_0201  [0201]
R31145  10K  RESISTOR_0201  [0201]
R31146  10K  RESISTOR_0201  [0201]
R31147  10K  RESISTOR_0201  [0201]
R31148  10K  RESISTOR_0201  [0201]
R31149  10K  RESISTOR_0201  [0201]
R31150  10K  RESISTOR_0201  [0201]
R31151  10K  RESISTOR_0201  [0201]
R31152  10K  RESISTOR_0201  [0201]
R31153  10K  RESISTOR_0201  [0201]
R31154  10K  RESISTOR_0201  [0201]
R31155  10K  RESISTOR_0201  [0201]
R31156  10K  RESISTOR_0201  [0201]
R31157  10K  RESISTOR_0201  [0201]
R31158  10K  RESISTOR_0201  [0201]
R31159  10K  RESISTOR_0201  [0201]
R31160  10K  RESISTOR_0201  [0201]
R31161  10K  RESISTOR_0201  [0201]
R31162  10K  RESISTOR_0201  [0201]
R31163  10K  RESISTOR_0201  [0201]
R31164  10K  RESISTOR_0201  [0201]
R31165  10K  RESISTOR_0201  [0201]
R31166  10K  RESISTOR_0201  [0201]
R31167  10K  RESISTOR_0201  [0201]
R31168  10K  RESISTOR_0201  [0201]
R31169  10K  RESISTOR_0201  [0201]
R31170  10K  RESISTOR_0201  [0201]
R31171  10K  RESISTOR_0201  [0201]
R31172  10K  RESISTOR_0201  [0201]
R31173  10K  RESISTOR_0201  [0201]
R31174  10K  RESISTOR_0201  [0201]
R31175  10K  RESISTOR_0201  [0201]
R31176  10K  RESISTOR_0201  [0201]
R31177  10K  RESISTOR_0201  [0201]
R31178  10K  RESISTOR_0201  [0201]
R31179  10K  RESISTOR_0201  [0201]
R31180  10K  RESISTOR_0201  [0201]
R31181  10K  RESISTOR_0201  [0201]
R31182  10K  RESISTOR_0201  [0201]
R31183  10K  RESISTOR_0201  [0201]
R31184  10K  RESISTOR_0201  [0201]
R31185  10K  RESISTOR_0201  [0201]
R31186  10K  RESISTOR_0201  [0201]
R31187  10K  RESISTOR_0201  [0201]
R31188  10K  RESISTOR_0201  [0201]
R31189  10K  RESISTOR_0201  [0201]
R31190  10K  RESISTOR_0201  [0201]
R31191  10K  RESISTOR_0201  [0201]
R31192  10K  RESISTOR_0201  [0201]
R31193  10K  RESISTOR_0201  [0201]
R31194  10K  RESISTOR_0201  [0201]
R31195  10K  RESISTOR_0201  [0201]
R31196  10K  RESISTOR_0201  [0201]
R31197  10K  RESISTOR_0201  [0201]
R31198  10K  RESISTOR_0201  [0201]
R31199  10K  RESISTOR_0201  [0201]
R31200  10K  RESISTOR_0201  [0201]
R31201  10K  RESISTOR_0201  [0201]
R31202  10K  RESISTOR_0201  [0201]
R31203  10K  RESISTOR_0201  [0201]
R31204  10K  RESISTOR_0201  [0201]
R31205  10K  RESISTOR_0201  [0201]
R31206  10K  RESISTOR_0201  [0201]
R31207  10K  RESISTOR_0201  [0201]
R31208  10K  RESISTOR_0201  [0201]
R31209  10K  RESISTOR_0201  [0201]
R31210  10K  RESISTOR_0201  [0201]
R31211  10K  RESISTOR_0201  [0201]
R31212  10K  RESISTOR_0201  [0201]
R31213  10K  RESISTOR_0201  [0201]
R31214  10K  RESISTOR_0201  [0201]
R31215  10K  RESISTOR_0201  [0201]
R31216  10K  RESISTOR_0201  [0201]
R31217  10K  RESISTOR_0201  [0201]
R31218  10K  RESISTOR_0201  [0201]
R31219  10K  RESISTOR_0201  [0201]
R31220  10K  RESISTOR_0201  [0201]
R31221  10K  RESISTOR_0201  [0201]
R31222  10K  RESISTOR_0201  [0201]
R31223  10K  RESISTOR_0201  [0201]
R31224  10K  RESISTOR_0201  [0201]
R31225  10K  RESISTOR_0201  [0201]
R31226  10K  RESISTOR_0201  [0201]
R31227  10K  RESISTOR_0201  [0201]
R31228  10K  RESISTOR_0201  [0201]
R31229  10K  RESISTOR_0201  [0201]
R31230  10K  RESISTOR_0201  [0201]
R31231  10K  RESISTOR_0201  [0201]
R31232  10K  RESISTOR_0201  [0201]
R31233  10K  RESISTOR_0201  [0201]
R31234  10K  RESISTOR_0201  [0201]
R31235  10K  RESISTOR_0201  [0201]
R31236  10K  RESISTOR_0201  [0201]
R31237  10K  RESISTOR_0201  [0201]
R31238  10K  RESISTOR_0201  [0201]
R31239  10K  RESISTOR_0201  [0201]
R31240  10K  RESISTOR_0201  [0201]
R31241  10K  RESISTOR_0201  [0201]
R31242  10K  RESISTOR_0201  [0201]
R31243  10K  RESISTOR_0201  [0201]
R31244  10K  RESISTOR_0201  [0201]
R31245  10K  RESISTOR_0201  [0201]
R31246  10K  RESISTOR_0201  [0201]
R31247  10K  RESISTOR_0201  [0201]
R31248  10K  RESISTOR_0201  [0201]
R31249  10K  RESISTOR_0201  [0201]
R31250  10K  RESISTOR_0201  [0201]
R31251  10K  RESISTOR_0201  [0201]
R31252  10K  RESISTOR_0201  [0201]
R31253  10K  RESISTOR_0201  [0201]
R31254  10K  RESISTOR_0201  [0201]
R31255  10K  RESISTOR_0201  [0201]
R31256  10K  RESISTOR_0201  [0201]
R31257  10K  RESISTOR_0201  [0201]
R31258  10K  RESISTOR_0201  [0201]
R31259  10K  RESISTOR_0201  [0201]
R31260  10K  RESISTOR_0201  [0201]
R31261  10K  RESISTOR_0201  [0201]
R31262  10K  RESISTOR_0201  [0201]
R31263  10K  RESISTOR_0201  [0201]
R31264  10K  RESISTOR_0201  [0201]
R31265  10K  RESISTOR_0201  [0201]
R31266  10K  RESISTOR_0201  [0201]
R31267  10K  RESISTOR_0201  [0201]
R31268  10K  RESISTOR_0201  [0201]
R31269  10K  RESISTOR_0201  [0201]
R31270  10K  RESISTOR_0201  [0201]
R31271  10K  RESISTOR_0201  [0201]
R31272  10K  RESISTOR_0201  [0201]
R31273  10K  RESISTOR_0201  [0201]
R31274  10K  RESISTOR_0201  [0201]
R31275  10K  RESISTOR_0201  [0201]
R31276  10K  RESISTOR_0201  [0201]
R31277  10K  RESISTOR_0201  [0201]
R31278  10K  RESISTOR_0201  [0201]
R31279  10K  RESISTOR_0201  [0201]
R31280  10K  RESISTOR_0201  [0201]
R31281  10K  RESISTOR_0201  [0201]
R31282  10K  RESISTOR_0201  [0201]
R31283  10K  RESISTOR_0201  [0201]
R31284  10K  RESISTOR_0201  [0201]
R31285  10K  RESISTOR_0201  [0201]
R31286  10K  RESISTOR_0201  [0201]
R31287  10K  RESISTOR_0201  [0201]
R31288  10K  RESISTOR_0201  [0201]
R31289  10K  RESISTOR_0201  [0201]
R31290  10K  RESISTOR_0201  [0201]
R31291  10K  RESISTOR_0201  [0201]
R31292  10K  RESISTOR_0201  [0201]
R31293  10K  RESISTOR_0201  [0201]
R31294  10K  RESISTOR_0201  [0201]
R31295  10K  RESISTOR_0201  [0201]
R31296  10K  RESISTOR_0201  [0201]
R31297  10K  RESISTOR_0201  [0201]
R31298  10K  RESISTOR_0201  [0201]
R31299  10K  RESISTOR_0201  [0201]
R31300  10K  RESISTOR_0201  [0201]
R31301  10K  RESISTOR_0201  [0201]
R31302  10K  RESISTOR_0201  [0201]
R31303  10K  RESISTOR_0201  [0201]
R31304  10K  RESISTOR_0201  [0201]
R31305  10K  RESISTOR_0201  [0201]
R31306  10K  RESISTOR_0201  [0201]
R31307  10K  RESISTOR_0201  [0201]
R31308  10K  RESISTOR_0201  [0201]
R31309  10K  RESISTOR_0201  [0201]
R31310  10K  RESISTOR_0201  [0201]
R31311  10K  RESISTOR_0201  [0201]
R31312  10K  RESISTOR_0201  [0201]
R31313  10K  RESISTOR_0201  [0201]
R31314  10K  RESISTOR_0201  [0201]
R31315  10K  RESISTOR_0201  [0201]
R31316  10K  RESISTOR_0201  [0201]
R31317  10K  RESISTOR_0201  [0201]
R31318  10K  RESISTOR_0201  [0201]
R31319  10K  RESISTOR_0201  [0201]
R31320  10K  RESISTOR_0201  [0201]
R31321  10K  RESISTOR_0201  [0201]
R31322  10K  RESISTOR_0201  [0201]
R31323  10K  RESISTOR_0201  [0201]
R31324  10K  RESISTOR_0201  [0201]
R31325  10K  RESISTOR_0201  [0201]
R31326  10K  RESISTOR_0201  [0201]
R31327  10K  RESISTOR_0201  [0201]
R31328  10K  RESISTOR_0201  [0201]
R31329  10K  RESISTOR_0201  [0201]
R31330  10K  RESISTOR_0201  [0201]
R31331  10K  RESISTOR_0201  [0201]
R31332  10K  RESISTOR_0201  [0201]
R31333  10K  RESISTOR_0201  [0201]
R31334  10K  RESISTOR_0201  [0201]
R31335  10K  RESISTOR_0201  [0201]
R31336  10K  RESISTOR_0201  [0201]
R31337  10K  RESISTOR_0201  [0201]
R31338  10K  RESISTOR_0201  [0201]
R31339  10K  RESISTOR_0201  [0201]
R31340  10K  RESISTOR_0201  [0201]
R31341  10K  RESISTOR_0201  [0201]
R31342  10K  RESISTOR_0201  [0201]
R31343  10K  RESISTOR_0201  [0201]
R31344  10K  RESISTOR_0201  [0201]
R31345  10K  RESISTOR_0201  [0201]
R31346  10K  RESISTOR_0201  [0201]
R31347  10K  RESISTOR_0201  [0201]
R31348  10K  RESISTOR_0201  [0201]
R31349  10K  RESISTOR_0201  [0201]
R31350  10K  RESISTOR_0201  [0201]
R31351  10K  RESISTOR_0201  [0201]
R31352  10K  RESISTOR_0201  [0201]
R31353  10K  RESISTOR_0201  [0201]
R31354  10K  RESISTOR_0201  [0201]
R31355  10K  RESISTOR_0201  [0201]
R31356  10K  RESISTOR_0201  [0201]
R31357  10K  RESISTOR_0201  [0201]
R31358  10K  RESISTOR_0201  [0201]
R31359  10K  RESISTOR_0201  [0201]
R31360  10K  RESISTOR_0201  [0201]
R31361  10K  RESISTOR_0201  [0201]
R31362  10K  RESISTOR_0201  [0201]
R31363  10K  RESISTOR_0201  [0201]
R31364  10K  RESISTOR_0201  [0201]
R31365  10K  RESISTOR_0201  [0201]
R31366  10K  RESISTOR_0201  [0201]
R31367  10K  RESISTOR_0201  [0201]
R31368  10K  RESISTOR_0201  [0201]
R31369  10K  RESISTOR_0201  [0201]
R31370  10K  RESISTOR_0201  [0201]
R31371  10K  RESISTOR_0201  [0201]
R31372  10K  RESISTOR_0201  [0201]
R31373  10K  RESISTOR_0201  [0201]
R31374  10K  RESISTOR_0201  [0201]
R31375  10K  RESISTOR_0201  [0201]
R31376  10K  RESISTOR_0201  [0201]
R31377  10K  RESISTOR_0201  [0201]
R31378  10K  RESISTOR_0201  [0201]
R31379  10K  RESISTOR_0201  [0201]
R31380  10K  RESISTOR_0201  [0201]
R31381  10K  RESISTOR_0201  [0201]
R31382  10K  RESISTOR_0201  [0201]
R31383  10K  RESISTOR_0201  [0201]
R31384  10K  RESISTOR_0201  [0201]
R31385  10K  RESISTOR_0201  [0201]
R31386  10K  RESISTOR_0201  [0201]
R31387  10K  RESISTOR_0201  [0201]
R31388  10K  RESISTOR_0201  [0201]
R31389  10K  RESISTOR_0201  [0201]
R31390  10K  RESISTOR_0201  [0201]
R31391  10K  RESISTOR_0201  [0201]
R31392  10K  RESISTOR_0201  [0201]
R31393  10K  RESISTOR_0201  [0201]
R31394  10K  RESISTOR_0201  [0201]
R31395  10K  RESISTOR_0201  [0201]
R31396  10K  RESISTOR_0201  [0201]
R31397  10K  RESISTOR_0201  [0201]
R31398  10K  RESISTOR_0201  [0201]
R31399  10K  RESISTOR_0201  [0201]
R31400  10K  RESISTOR_0201  [0201]
R31401  10K  RESISTOR_0201  [0201]
R31402  10K  RESISTOR_0201  [0201]
R31403  10K  RESISTOR_0201  [0201]
R31404  10K  RESISTOR_0201  [0201]
R31405  10K  RESISTOR_0201  [0201]
R31406  10K  RESISTOR_0201  [0201]
R31407  10K  RESISTOR_0201  [0201]
R31408  10K  RESISTOR_0201  [0201]
R31409  10K  RESISTOR_0201  [0201]
R31410  10K  RESISTOR_0201  [0201]
R31411  10K  RESISTOR_0201  [0201]
R31412  10K  RESISTOR_0201  [0201]
R31413  10K  RESISTOR_0201  [0201]
R31414  10K  RESISTOR_0201  [0201]
R31415  10K  RESISTOR_0201  [0201]
R31416  10K  RESISTOR_0201  [0201]
R31417  10K  RESISTOR_0201  [0201]
R31418  10K  RESISTOR_0201  [0201]
R31419  10K  RESISTOR_0201  [0201]
R31420  10K  RESISTOR_0201  [0201]
R31421  10K  RESISTOR_0201  [0201]
R31422  10K  RESISTOR_0201  [0201]
R31423  10K  RESISTOR_0201  [0201]
R31424  10K  RESISTOR_0201  [0201]
R31425  10K  RESISTOR_0201  [0201]
R31426  10K  RESISTOR_0201  [0201]
R31427  10K  RESISTOR_0201  [0201]
R31428  10K  RESISTOR_0201  [0201]
R31429  10K  RESISTOR_0201  [0201]
R31430  10K  RESISTOR_0201  [0201]
R31431  10K  RESISTOR_0201  [0201]
R31432  10K  RESISTOR_0201  [0201]
R31433  10K  RESISTOR_0201  [0201]
R31434  10K  RESISTOR_0201  [0201]
R31435  10K  RESISTOR_0201  [0201]
R31436  10K  RESISTOR_0201  [0201]
R31437  10K  RESISTOR_0201  [0201]
R31438  10K  RESISTOR_0201  [0201]
R31439  10K  RESISTOR_0201  [0201]
R31440  10K  RESISTOR_0201  [0201]
R31441  10K  RESISTOR_0201  [0201]
R31442  10K  RESISTOR_0201  [0201]
R31443  10K  RESISTOR_0201  [0201]
R31444  10K  RESISTOR_0201  [0201]
R31445  10K  RESISTOR_0201  [0201]
R31446  10K  RESISTOR_0201  [0201]
R31447  10K  RESISTOR_0201  [0201]
R31448  10K  RESISTOR_0201  [0201]
R31449  10K  RESISTOR_0201  [0201]
R31450  10K  RESISTOR_0201  [0201]
R31451  10K  RESISTOR_0201  [0201]
R31452  10K  RESISTOR_0201  [0201]
R31453  10K  RESISTOR_0201  [0201]
R31454  10K  RESISTOR_0201  [0201]
R31455  10K  RESISTOR_0201  [0201]
R31456  10K  RESISTOR_0201  [0201]
R31457  10K  RESISTOR_0201  [0201]
R31458  10K  RESISTOR_0201  [0201]
R31459  10K  RESISTOR_0201  [0201]
R31460  10K  RESISTOR_0201  [0201]
R31461  10K  RESISTOR_0201  [0201]
R31462  10K  RESISTOR_0201  [0201]
R31463  10K  RESISTOR_0201  [0201]
R31464  10K  RESISTOR_0201  [0201]
R31465  10K  RESISTOR_0201  [0201]
R31466  10K  RESISTOR_0201  [0201]
R31467  10K  RESISTOR_0201  [0201]
R31468  10K  RESISTOR_0201  [0201]
R31469  10K  RESISTOR_0201  [0201]
R31470  10K  RESISTOR_0201  [0201]
R31471  10K  RESISTOR_0201  [0201]
R31472  10K  RESISTOR_0201  [0201]
R31473  10K  RESISTOR_0201  [0201]
R31474  10K  RESISTOR_0201  [0201]
R31475  10K  RESISTOR_0201  [0201]
R31476  10K  RESISTOR_0201  [0201]
R31477  10K  RESISTOR_0201  [0201]
R31478  10K  RESISTOR_0201  [0201]
R31479  10K  RESISTOR_0201  [0201]
R31480  10K  RESISTOR_0201  [0201]
R31481  10K  RESISTOR_0201  [0201]
R31482  10K  RESISTOR_0201  [0201]
R31483  10K  RESISTOR_0201  [0201]
R31484  10K  RESISTOR_0201  [0201]
R31485  10K  RESISTOR_0201  [0201]
R31486  10K  RESISTOR_0201  [0201]
R31487  10K  RESISTOR_0201  [0201]
R31488  10K  RESISTOR_0201  [0201]
R31489  10K  RESISTOR_0201  [0201]
R31490  10K  RESISTOR_0201  [0201]
R31491  10K  RESISTOR_0201  [0201]
R31492  10K  RESISTOR_0201  [0201]
R31493  10K  RESISTOR_0201  [0201]
R31494  10K  RESISTOR_0201  [0201]
R31495  10K  RESISTOR_0201  [0201]
R31496  10K  RESISTOR_0201  [0201]
R31497  10K  RESISTOR_0201  [0201]
R31498  10K  RESISTOR_0201  [0201]
R31499  10K  RESISTOR_0201  [0201]
R31500  10K  RESISTOR_0201  [0201]
R31501  10K  RESISTOR_0201  [0201]
R31502  10K  RESISTOR_0201  [0201]
R31503  10K  RESISTOR_0201  [0201]
R31504  10K  RESISTOR_0201  [0201]
R31505  10K  RESISTOR_0201  [0201]
R31506  10K  RESISTOR_0201  [0201]
R31507  10K  RESISTOR_0201  [0201]
R31508  10K  RESISTOR_0201  [0201]
R31509  10K  RESISTOR_0201  [0201]
R31510  10K  RESISTOR_0201  [0201]
R31511  10K  RESISTOR_0201  [0201]
R31512  10K  RESISTOR_0201  [0201]
R31513  10K  RESISTOR_0201  [0201]
R31514  10K  RESISTOR_0201  [0201]
R31515  10K  RESISTOR_0201  [0201]
R31516  10K  RESISTOR_0201  [0201]
R31517  10K  RESISTOR_0201  [0201]
R31518  10K  RESISTOR_0201  [0201]
R31519  10K  RESISTOR_0201  [0201]
R31520  10K  RESISTOR_0201  [0201]
R31521  10K  RESISTOR_0201  [0201]
R31522  10K  RESISTOR_0201  [0201]
R31523  10K  RESISTOR_0201  [0201]
R31524  10K  RESISTOR_0201  [0201]
R31525  10K  RESISTOR_0201  [0201]
R31526  10K  RESISTOR_0201  [0201]
R31527  10K  RESISTOR_0201  [0201]
R31528  10K  RESISTOR_0201  [0201]
R31529  10K  RESISTOR_0201  [0201]
R31530  10K  RESISTOR_0201  [0201]
R31531  10K  RESISTOR_0201  [0201]
R31532  10K  RESISTOR_0201  [0201]
R31533  10K  RESISTOR_0201  [0201]
R31534  10K  RESISTOR_0201  [0201]
R31535  10K  RESISTOR_0201  [0201]
R31536  10K  RESISTOR_0201  [0201]
R31537  10K  RESISTOR_0201  [0201]